# EasyEDA Pro project 嵌入式.eprj, board 显示 (continued)
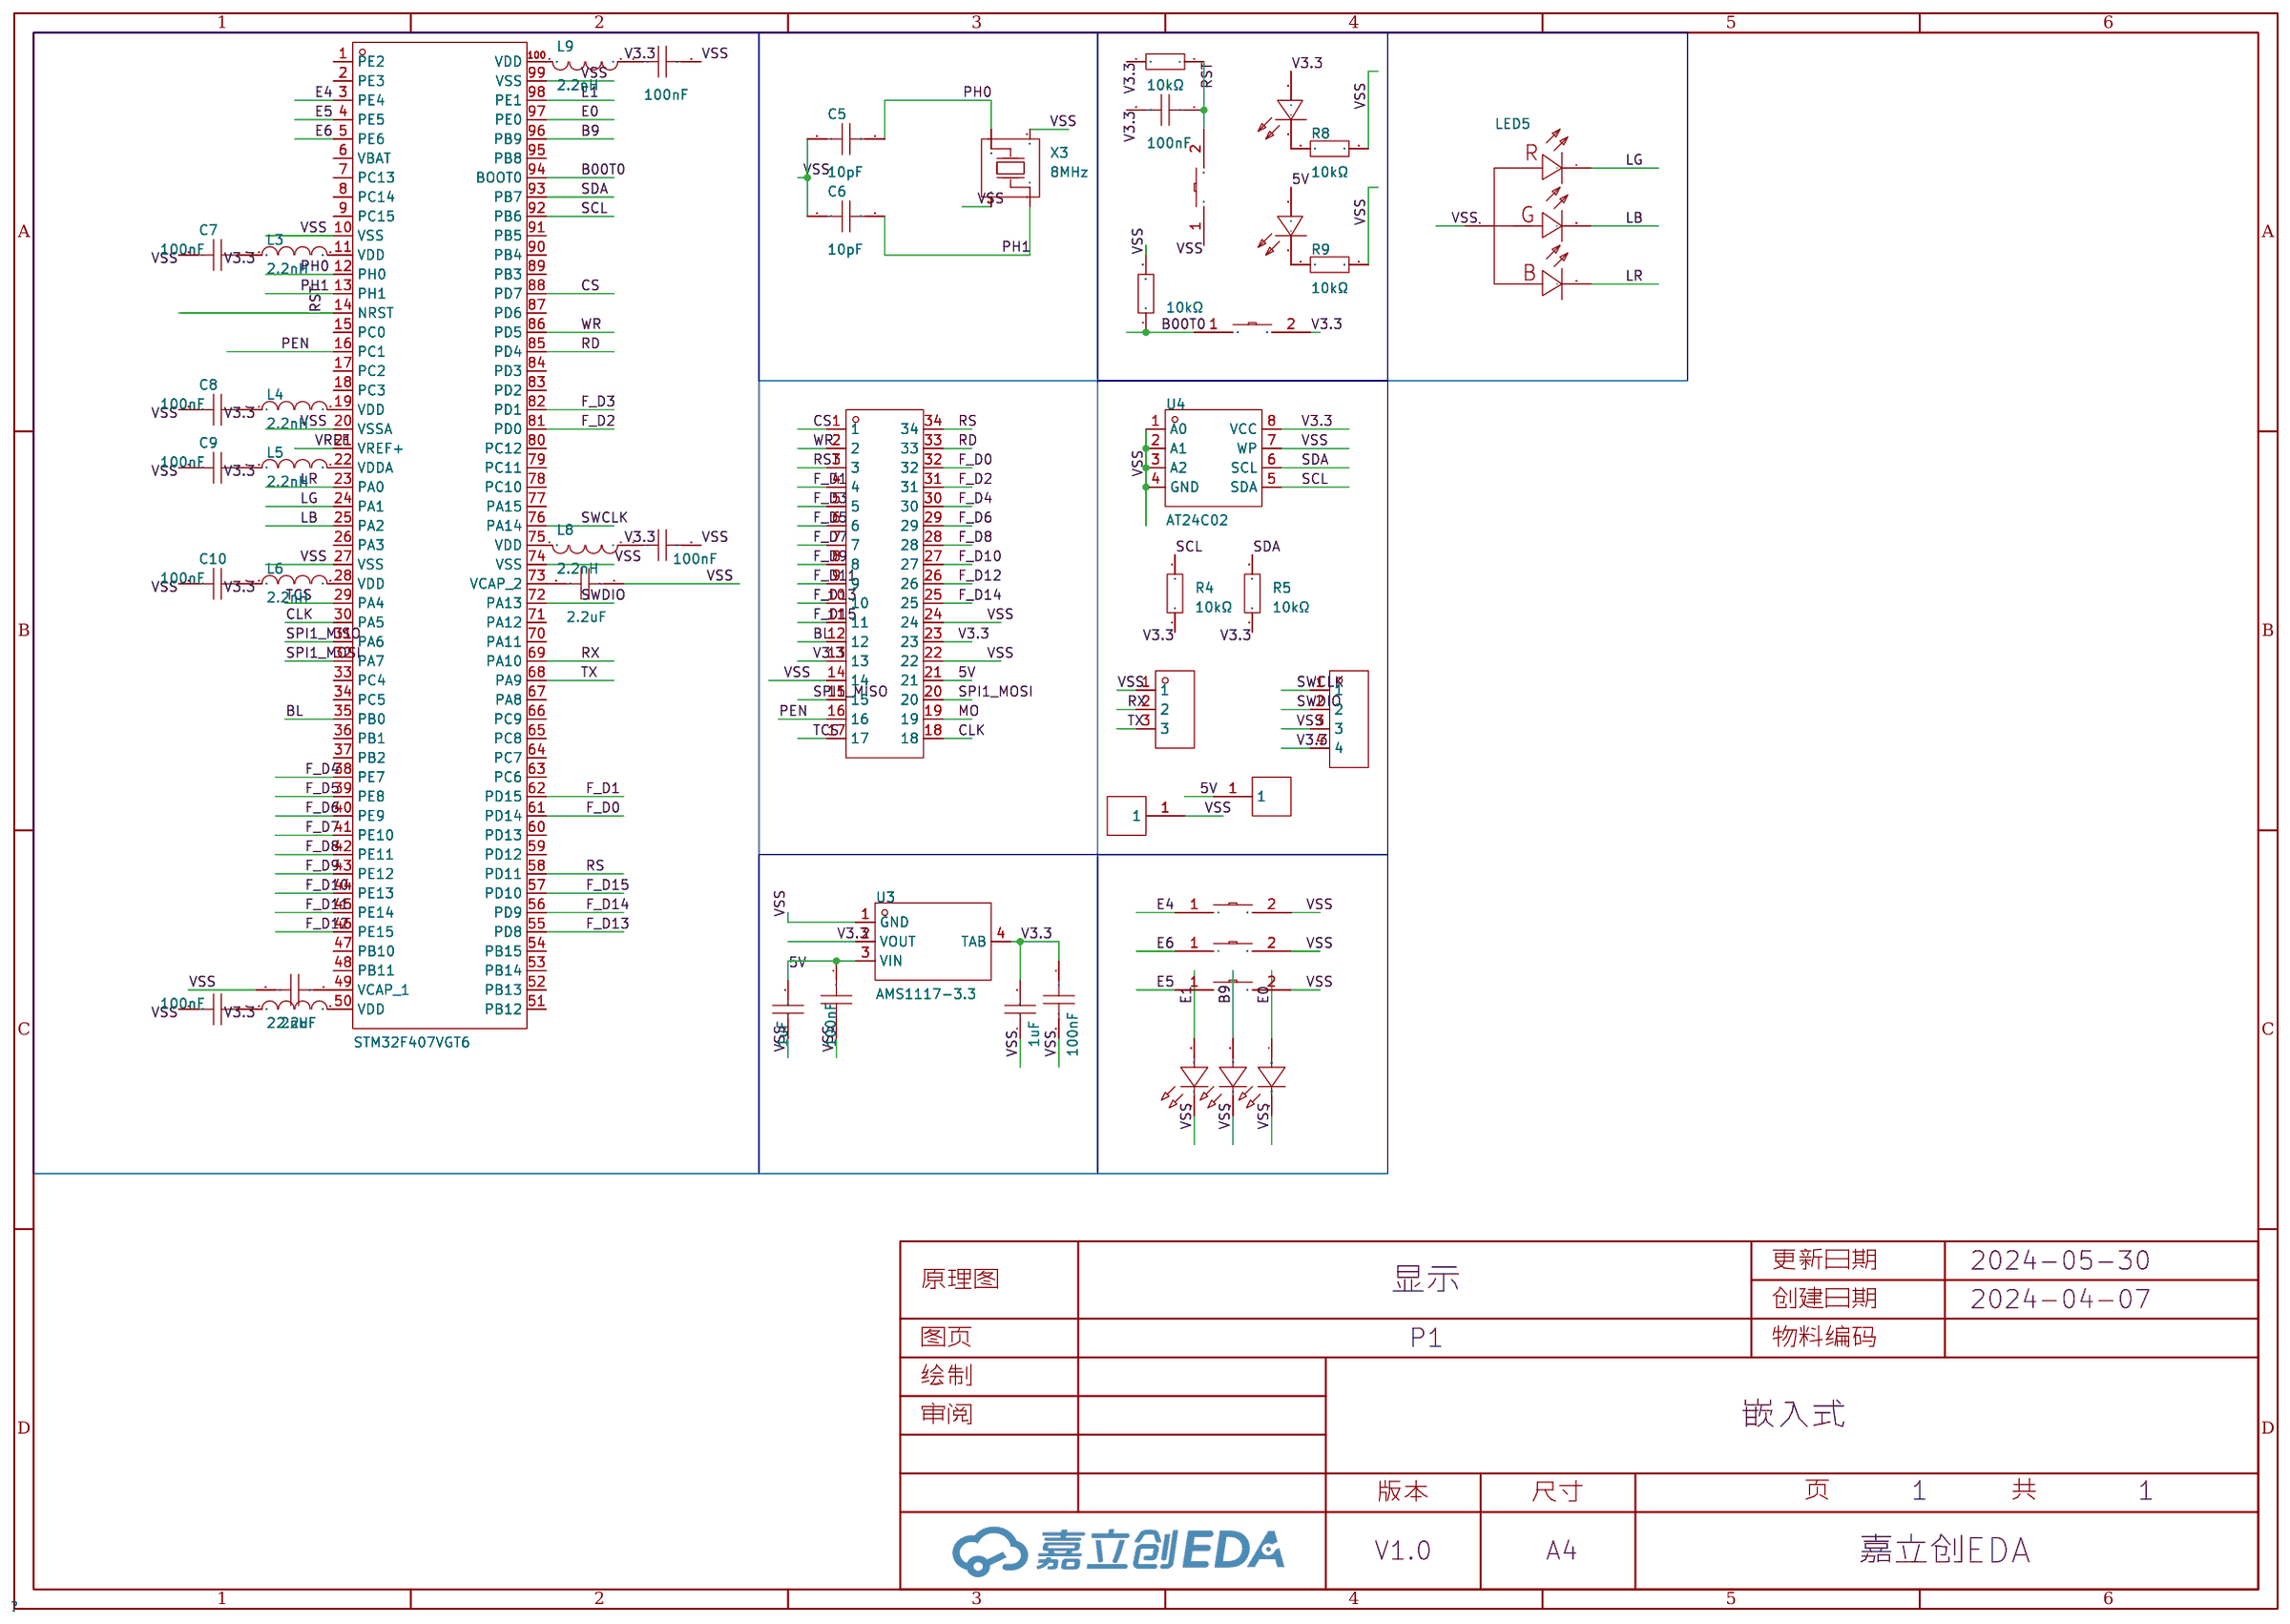
[diagram p0: schematic sheet]
## Routing (per net, layer and track width the routed paths; a pad name or vN(x,y) marks a point on that pad's centre or on a via; arc(x,y) is an arc through that point) (continued)
 v1(37.85,24.43) v1(37.85,23.42) v1(37.85,22.4) v1(37.85,21.39) v1(37.85,20.37) v1(37.85,19.35) v1(37.85,18.34) v1(37.85,17.32) v1(37.85,16.31) v1(37.85,15.29) v1(37.85,14.27) v1(37.85,13.26) v1(37.85,12.24) v1(37.85,11.23) v1(37.85,10.21) v1(37.85,9.19) v1(37.85,8.18) v1(37.85,7.16) v1(37.85,6.15) v1(37.85,5.13) v1(37.85,4.11) v1(37.85,3.1) v1(37.85,2.08) v1(37.85,1.07) v1(38.86,81.33) v1(38.86,78.28) v1(38.86,76.25) v1(38.86,75.23) v1(38.86,70.15) v1(38.86,66.09) v1(38.86,65.07) v1(38.86,58.98) v1(38.86,57.96) v1(38.86,56.95) v1(38.86,55.93) v1(38.86,54.91) v1(38.86,52.88) v1(38.86,51.87) v1(38.86,50.85) v1(38.86,48.82) v1(38.86,47.8) v1(38.86,46.79) v1(38.86,45.77) v1(38.86,38.66) v1(38.86,32.56) v1(38.86,31.55) v1(38.86,30.53) v1(38.86,29.51) v1(38.86,27.48) v1(38.86,26.47) v1(38.86,25.45) v1(38.86,24.43) v1(38.86,23.42) v1(38.86,22.4) v1(38.86,21.39) v1(38.86,20.37) v1(38.86,19.35) v1(38.86,18.34) v1(38.86,17.32) v1(38.86,16.31) v1(38.86,15.29) v1(38.86,14.27) v1(38.86,13.26) v1(38.86,12.24) v1(38.86,11.23) v1(38.86,10.21) v1(38.86,9.19) v1(38.86,8.18) v1(38.86,7.16) v1(38.86,6.15) v1(38.86,5.13) v1(38.86,4.11) v1(38.86,3.1) v1(38.86,2.08) v1(38.86,1.07) v1(39.88,81.33) v1(39.88,75.23) v1(39.88,71.17) v1(39.88,67.11) v1(39.88,66.09) v1(39.88,65.07) v1(39.88,59.99) v1(39.88,58.98) v1(39.88,57.96) v1(39.88,56.95) v1(39.88,55.93) v1(39.88,54.91) v1(39.88,53.9) v1(39.88,52.88) v1(39.88,51.87) v1(39.88,50.85) v1(39.88,48.82) v1(39.88,47.8) v1(39.88,46.79) v1(39.88,45.77) v1(39.88,41.71) v1(39.88,40.69) v1(39.88,37.64) v1(39.88,31.55) v1(39.88,30.53) v1(39.88,29.51) v1(39.88,28.5) v1(39.88,27.48) v1(39.88,26.47) v1(39.88,25.45) v1(39.88,24.43) v1(39.88,23.42) v1(39.88,22.4) v1(39.88,21.39) v1(39.88,20.37) v1(39.88,19.35) v1(39.88,18.34) v1(39.88,17.32) v1(39.88,16.31) v1(39.88,15.29) v1(39.88,14.27) v1(39.88,13.26) v1(39.88,12.24) v1(39.88,11.23) v1(39.88,10.21) v1(39.88,9.19) v1(39.88,8.18) v1(39.88,7.16) v1(39.88,6.15) v1(39.88,5.13) v1(39.88,4.11) v1(39.88,3.1) v1(39.88,2.08) v1(39.88,1.07) v1(40.89,81.33) v1(40.89,68.12) v1(40.89,67.11) v1(40.89,66.09) v1(40.89,65.07) v1(40.89,61.01) v1(40.89,59.99) v1(40.89,58.98) v1(40.89,57.96) v1(40.89,56.95) v1(40.89,55.93) v1(40.89,54.91) v1(40.89,53.9) v1(40.89,52.88) v1(40.89,51.87) v1(40.89,50.85) v1(40.89,48.82) v1(40.89,47.8) v1(40.89,46.79) v1(40.89,45.77) v1(40.89,42.72) v1(40.89,41.71) v1(40.89,40.69) v1(40.89,39.67) v1(40.89,30.53) v1(40.89,29.51) v1(40.89,28.5) v1(40.89,27.48) v1(40.89,26.47) v1(40.89,25.45) v1(40.89,24.43) v1(40.89,23.42) v1(40.89,22.4) v1(40.89,21.39) v1(40.89,20.37) v1(40.89,19.35) v1(40.89,18.34) v1(40.89,17.32) v1(40.89,16.31) v1(40.89,15.29) v1(40.89,14.27) v1(40.89,13.26) v1(40.89,12.24) v1(40.89,11.23) v1(40.89,10.21) v1(40.89,9.19) v1(40.89,8.18) v1(40.89,7.16) v1(40.89,6.15) v1(40.89,5.13) v1(40.89,4.11) v1(40.89,3.1) v1(40.89,2.08) v1(40.89,1.07) v1(41.91,81.33) v1(41.91,78.28) v1(41.91,75.23) v1(41.91,74.22) v1(41.91,73.2) v1(41.91,69.14) v1(41.91,68.12) v1(41.91,67.11) v1(41.91,66.09) v1(41.91,65.07) v1(41.91,61.01) v1(41.91,59.99) v1(41.91,58.98) v1(41.91,57.96) v1(41.91,56.95) v1(41.91,55.93) v1(41.91,54.91) v1(41.91,53.9) v1(41.91,52.88) v1(41.91,51.87) v1(41.91,50.85) v1(41.91,48.82) v1(41.91,47.8) v1(41.91,46.79) v1(41.91,45.77) v1(41.91,42.72) v1(41.91,41.71) v1(41.91,40.69) v1(41.91,39.67) v1(41.91,38.66) v1(41.91,35.61) v1(41.91,30.53) v1(41.91,29.51) v1(41.91,28.5) v1(41.91,27.48) v1(41.91,26.47) v1(41.91,25.45) v1(41.91,24.43) v1(41.91,23.42) v1(41.91,22.4) v1(41.91,21.39) v1(41.91,20.37) v1(41.91,19.35) v1(41.91,18.34) v1(41.91,17.32) v1(41.91,16.31) v1(41.91,15.29) v1(41.91,14.27) v1(41.91,13.26) v1(41.91,12.24) v1(41.91,11.23) v1(41.91,10.21) v1(41.91,9.19) v1(41.91,8.18) v1(41.91,7.16) v1(41.91,6.15) v1(41.91,5.13) v1(41.91,4.11) v1(41.91,3.1) v1(41.91,2.08) v1(41.91,1.07) v1(42.93,81.33) v1(42.93,75.23) v1(42.93,74.22) v1(42.93,70.15) v1(42.93,69.14) v1(42.93,68.12) v1(42.93,67.11) v1(42.93,66.09) v1(42.93,61.01) v1(42.93,59.99) v1(42.93,58.98) v1(42.93,57.96) v1(42.93,56.95) v1(42.93,55.93) v1(42.93,54.91) v1(42.93,53.9) v1(42.93,52.88) v1(42.93,51.87) v1(42.93,50.85) v1(42.93,48.82) v1(42.93,47.8) v1(42.93,46.79) v1(42.93,42.72) v1(42.93,41.71) v1(42.93,40.69) v1(42.93,39.67) v1(42.93,38.66) v1(42.93,34.59) v1(42.93,29.51) v1(42.93,28.5) v1(42.93,27.48) v1(42.93,26.47) v1(42.93,25.45) v1(42.93,24.43) v1(42.93,23.42) v1(42.93,22.4) v1(42.93,21.39) v1(42.93,20.37) v1(42.93,19.35) v1(42.93,18.34) v1(42.93,17.32) v1(42.93,16.31) v1(42.93,15.29) v1(42.93,14.27) v1(42.93,13.26) v1(42.93,12.24) v1(42.93,11.23) v1(42.93,10.21) v1(42.93,9.19) v1(42.93,8.18) v1(42.93,7.16) v1(42.93,6.15) v1(42.93,5.13) v1(42.93,4.11) v1(42.93,3.1) v1(42.93,2.08) v1(42.93,1.07) v1(43.94,81.33) v1(43.94,75.23) v1(43.94,70.15) v1(43.94,69.14) v1(43.94,68.12) v1(43.94,67.11) v1(43.94,61.01) v1(43.94,59.99) v1(43.94,58.98) v1(43.94,57.96) v1(43.94,56.95) v1(43.94,55.93) v1(43.94,54.91) v1(43.94,53.9) v1(43.94,52.88) v1(43.94,51.87) v1(43.94,50.85) v1(43.94,48.82) v1(43.94,47.8) v1(43.94,46.79) v1(43.94,42.72) v1(43.94,41.71) v1(43.94,40.69) v1(43.94,39.67) v1(43.94,38.66) v1(43.94,33.58) v1(43.94,28.5) v1(43.94,27.48) v1(43.94,26.47) v1(43.94,25.45) v1(43.94,24.43) v1(43.94,23.42) v1(43.94,22.4) v1(43.94,21.39) v1(43.94,20.37) v1(43.94,19.35) v1(43.94,18.34) v1(43.94,17.32) v1(43.94,16.31) v1(43.94,15.29) v1(43.94,14.27) v1(43.94,13.26) v1(43.94,12.24) v1(43.94,11.23) v1(43.94,10.21) v1(43.94,9.19) v1(43.94,8.18) v1(43.94,7.16) v1(43.94,6.15) v1(43.94,5.13) v1(43.94,4.11) v1(43.94,3.1) v1(43.94,2.08) v1(43.94,1.07) v1(44.96,81.33) v1(44.96,72.19) v1(44.96,70.15) v1(44.96,69.14) v1(44.96,68.12) v1(44.96,65.07) v1(44.96,61.01) v1(44.96,59.99) v1(44.96,58.98) v1(44.96,57.96) v1(44.96,56.95) v1(44.96,55.93) v1(44.96,54.91) v1(44.96,53.9) v1(44.96,52.88) v1(44.96,51.87) v1(44.96,50.85) v1(44.96,48.82) v1(44.96,47.8) v1(44.96,46.79) v1(44.96,42.72) v1(44.96,41.71) v1(44.96,40.69) v1(44.96,39.67) v1(44.96,38.66) v1(44.96,32.56) v1(44.96,27.48) v1(44.96,26.47) v1(44.96,25.45) v1(44.96,24.43) v1(44.96,23.42) v1(44.96,22.4) v1(44.96,21.39) v1(44.96,20.37) v1(44.96,19.35) v1(44.96,18.34) v1(44.96,17.32) v1(44.96,16.31) v1(44.96,15.29) v1(44.96,14.27) v1(44.96,13.26) v1(44.96,12.24) v1(44.96,11.23) v1(44.96,10.21) v1(44.96,9.19) v1(44.96,8.18) v1(44.96,7.16) v1(44.96,6.15) v1(44.96,5.13) v1(44.96,4.11) v1(44.96,3.1) v1(44.96,2.08) v1(44.96,1.07) v1(45.97,81.33) v1(45.97,73.2) v1(45.97,72.19) v1(45.97,70.15) v1(45.97,69.14) v1(45.97,66.09) v1(45.97,65.07) v1(45.97,61.01) v1(45.97,59.99) v1(45.97,58.98) v1(45.97,57.96) v1(45.97,56.95) v1(45.97,55.93) v1(45.97,54.91) v1(45.97,53.9) v1(45.97,52.88) v1(45.97,51.87) v1(45.97,50.85) v1(45.97,48.82) v1(45.97,47.8) v1(45.97,46.79) v1(45.97,45.77) v1(45.97,43.74) v1(45.97,42.72) v1(45.97,41.71) v1(45.97,40.69) v1(45.97,39.67) v1(45.97,38.66) v1(45.97,37.64) v1(45.97,36.63) v1(45.97,35.61) v1(45.97,34.59) v1(45.97,31.55) v1(45.97,26.47) v1(45.97,25.45) v1(45.97,24.43) v1(45.97,23.42) v1(45.97,22.4) v1(45.97,21.39) v1(45.97,20.37) v1(45.97,19.35) v1(45.97,18.34) v1(45.97,17.32) v1(45.97,16.31) v1(45.97,15.29) v1(45.97,14.27) v1(45.97,13.26) v1(45.97,12.24) v1(45.97,11.23) v1(45.97,10.21) v1(45.97,9.19) v1(45.97,8.18) v1(45.97,7.16) v1(45.97,6.15) v1(45.97,5.13) v1(45.97,1.07) v1(46.99,81.33) v1(46.99,78.28) v1(46.99,76.25) v1(46.99,75.23) v1(46.99,74.22) v1(46.99,73.2) v1(46.99,72.19) v1(46.99,70.15) v1(46.99,67.11) v1(46.99,66.09) v1(46.99,65.07) v1(46.99,61.01) v1(46.99,59.99) v1(46.99,58.98) v1(46.99,57.96) v1(46.99,56.95) v1(46.99,55.93) v1(46.99,54.91) v1(46.99,53.9) v1(46.99,52.88) v1(46.99,51.87) v1(46.99,50.85) v1(46.99,48.82) v1(46.99,47.8) v1(46.99,46.79) v1(46.99,45.77) v1(46.99,43.74) v1(46.99,42.72) v1(46.99,41.71) v1(46.99,40.69) v1(46.99,39.67) v1(46.99,38.66) v1(46.99,37.64) v1(46.99,36.63) v1(46.99,35.61) v1(46.99,34.59) v1(46.99,33.58) v1(46.99,30.53) v1(46.99,25.45) v1(46.99,24.43) v1(46.99,23.42) v1(46.99,22.4) v1(46.99,21.39) v1(46.99,20.37) v1(46.99,19.35) v1(46.99,18.34) v1(46.99,17.32) v1(46.99,16.31) v1(46.99,15.29) v1(46.99,14.27) v1(46.99,13.26) v1(46.99,12.24) v1(46.99,11.23) v1(46.99,10.21) v1(46.99,9.19) v1(46.99,8.18) v1(46.99,7.16) v1(46.99,6.15) v1(48.01,81.33) v1(48.01,80.31) v1(48.01,79.3) v1(48.01,78.28) v1(48.01,77.27) v1(48.01,76.25) v1(48.01,75.23) v1(48.01,74.22) v1(48.01,73.2) v1(48.01,72.19) v1(48.01,68.12) v1(48.01,67.11) v1(48.01,66.09) v1(48.01,65.07) v1(48.01,61.01) v1(48.01,59.99) v1(48.01,58.98) v1(48.01,57.96) v1(48.01,56.95) v1(48.01,55.93) v1(48.01,54.91) v1(48.01,53.9) v1(48.01,52.88) v1(48.01,51.87) v1(48.01,50.85) v1(48.01,48.82) v1(48.01,47.8) v1(48.01,46.79) v1(48.01,45.77) v1(48.01,44.75) v1(48.01,42.72) v1(48.01,41.71) v1(48.01,40.69) v1(48.01,39.67) v1(48.01,38.66) v1(48.01,37.64) v1(48.01,36.63) v1(48.01,35.61) v1(48.01,34.59) v1(48.01,33.58) v1(48.01,32.56) v1(48.01,29.51) v1(48.01,24.43) v1(48.01,23.42) v1(48.01,22.4) v1(48.01,21.39) v1(48.01,20.37) v1(48.01,19.35) v1(48.01,18.34) v1(48.01,17.32) v1(48.01,16.31) v1(48.01,15.29) v1(48.01,14.27) v1(48.01,13.26) v1(48.01,12.24) v1(48.01,11.23) v1(48.01,10.21) v1(48.01,9.19) v1(48.01,8.18) v1(48.01,7.16) v1(48.01,6.15) v1(49.02,81.33) v1(49.02,80.31) v1(49.02,79.3) v1(49.02,78.28) v1(49.02,77.27) v1(49.02,76.25) v1(49.02,75.23) v1(49.02,74.22) v1(49.02,73.2) v1(49.02,69.14) v1(49.02,68.12) v1(49.02,67.11) v1(49.02,66.09) v1(49.02,65.07) v1(49.02,61.01) v1(49.02,59.99) v1(49.02,58.98) v1(49.02,57.96) v1(49.02,56.95) v1(49.02,55.93) v1(49.02,54.91) v1(49.02,53.9) v1(49.02,52.88) v1(49.02,51.87) v1(49.02,50.85) v1(49.02,48.82) v1(49.02,47.8) v1(49.02,46.79) v1(49.02,45.77) v1(49.02,44.75) v1(49.02,43.74) v1(49.02,41.71) v1(49.02,40.69) v1(49.02,39.67) v1(49.02,38.66) v1(49.02,37.64) v1(49.02,36.63) v1(49.02,35.61) v1(49.02,34.59) v1(49.02,33.58) v1(49.02,32.56) v1(49.02,31.55) v1(49.02,28.5) v1(49.02,23.42) v1(49.02,22.4) v1(49.02,21.39) v1(49.02,20.37) v1(49.02,19.35) v1(49.02,18.34) v1(49.02,17.32) v1(49.02,16.31) v1(49.02,15.29) v1(49.02,14.27) v1(49.02,13.26) v1(49.02,12.24) v1(49.02,11.23) v1(49.02,10.21) v1(49.02,9.19) v1(49.02,8.18) v1(49.02,7.16) v1(49.02,6.15) v1(50.04,81.33) v1(50.04,80.31) v1(50.04,79.3) v1(50.04,78.28) v1(50.04,77.27) v1(50.04,76.25) v1(50.04,75.23) v1(50.04,74.22) v1(50.04,69.14) v1(50.04,68.12) v1(50.04,67.11) v1(50.04,66.09) v1(50.04,65.07) v1(50.04,61.01) v1(50.04,59.99) v1(50.04,58.98) v1(50.04,57.96) v1(50.04,56.95) v1(50.04,55.93) v1(50.04,54.91) v1(50.04,53.9) v1(50.04,52.88) v1(50.04,51.87) v1(50.04,50.85) v1(50.04,48.82) v1(50.04,47.8) v1(50.04,46.79) v1(50.04,45.77) v1(50.04,44.75) v1(50.04,43.74) v1(50.04,42.72) v1(50.04,40.69) v1(50.04,39.67) v1(50.04,38.66) v1(50.04,37.64) v1(50.04,36.63) v1(50.04,35.61) v1(50.04,34.59) v1(50.04,33.58) v1(50.04,32.56) v1(50.04,31.55) v1(50.04,30.53) v1(50.04,27.48) v1(50.04,22.4) v1(50.04,21.39) v1(50.04,20.37) v1(50.04,19.35) v1(50.04,18.34) v1(50.04,17.32) v1(50.04,16.31) v1(50.04,15.29) v1(50.04,14.27) v1(50.04,13.26) v1(50.04,12.24) v1(50.04,11.23) v1(50.04,10.21) v1(50.04,9.19) v1(50.04,8.18) v1(50.04,7.16) v1(50.04,6.15) v1(50.04,5.13) v1(50.04,1.07) v2(3.67,64.54) v2(6.31,64.54) v2(8.68,64.54) v2(10.41,64.54) v2(12.64,64.54) v2(14.79,64.54) v2(16.99,3.63) v2(17.24,64.54) v2(18.46,64.54) v2(22.31,64.54) v2(24.44,64.54) v2(24.99,49.78) v2(26.44,44.6) v2(27.38,64.74) v2(29.24,41.43) v2(33.71,64.59) v2(35.79,64.59) v2(38.53,64.59) v2(41.02,64.59) v2(45.38,64.59) v2(47.92,64.59)
B00T0: length 12.8
  Top Layer w0.165: U1.94 36.11,36.89 R7.1 43.89,36.89 SW3.1
B9: length 45.5
  Top Layer w0.165: 33.31,41.1 34.39,40.02 v2(34.39,39.45) ; v2(52.55,5.33) 54.24,5.33 LED1.5
  Inner1 w0.165: v2(34.39,39.45) 52.55,21.28 v2(52.55,5.33)
BL: length 33.6
  Top Layer w0.165: U1.35 19.43,51.45 19.43,56.06 33.12,69.75 U2.12
CLK: length 40.6
  Top Layer w0.165: v2(23.55,50.32) 23.55,50.87 U1.30
  Inner2 w0.165: U2.18 44.5,78.55 44.5,74.12 23.55,53.16 v2(23.55,50.32)
CS: length 70.4
  Top Layer w0.165: U1.88 30.61,38.27 v2(32.26,36.63)
  Inner2 w0.165: v2(32.26,36.63) 28.35,32.71 14.27,32.71 5.18,41.81 U2.1
E0: length 42.8
  Top Layer w0.165: U1.97 v2(35.22,39.9) 35.23,39.9
  Inner1 w0.165: v2(35.22,39.9) 53.98,21.15 53.98,7.03
  vias: v2(53.97,6.98)
E1: length 46.8
  Top Layer w0.165: U1.98 35.34,40.49 v2(35.51,40.49)
  Inner1 w0.165: v2(35.51,40.49) 54.74,21.26 54.74,3.73
  vias: v2(54.74,3.95)
E4: length 40.3
  Top Layer w0.165: U1.3 31.86,43.26 v2(30.76,43.26)
  Inner1 w0.165: v2(30.76,43.26) 35.97,43.26 v2(57.86,21.36)
E5: length 36.6
  Top Layer w0.165: v2(30.1,44.86) 30.71,44.25 32.14,44.25 U1.4
  Inner1 w0.165: 57.84,34.09 47.07,44.86 v2(30.1,44.86)
  vias: v2(57.89,34.09)
E6: length 35.2
  Top Layer w0.165: 33.31,46.12 32.35,45.16 31.37,45.16 v2(30.58,45.95)
  Inner1 w0.165: v2(58.09,46.02) 58.09,48.21 56.72,49.58 34.21,49.58 v2(30.58,45.95)
F_D0: length 51
  Top Layer w0.165: U1.61 16.52,36.4 v2(16.38,36.4)
  Bottom Layer w0.165: U2.32 11.53,78.6 11.53,44.32 10.11,42.9 10.11,42.67 v2(16.38,36.4)
F_D1: length 44.1
  Top Layer w0.165: 19.45,38.63 19.45,38.53 v2(18.42,37.49)
  Bottom Layer w0.165: v2(18.42,37.49) 17.73,37.49 13.67,41.55 13.67,76.47 U2.4
F_D2: length 54.5
  Top Layer w0.165: v2(26.9,36.8) 27.91,35.8 U1.81
  Bottom Layer w0.165: v2(26.9,36.8) 25.5,35.41 23.29,35.41 14.15,44.55 14.15,78.52 U2.31
F_D3: length 50.3
  Top Layer w0.165: v2(26.57,37.72) 26.8,37.72 U1.82
  Bottom Layer w0.165: v2(26.57,37.72) 25.6,36.75 22.83,36.75 15.34,44.25 U2.5
F_D4: length 49.6
  Top Layer w0.165: v2(22.58,46.68) 22.07,46.68 U1.38
  Bottom Layer w0.165: v2(22.58,46.68) 22.58,44.45 21.03,42.9 17.45,42.9 16.61,43.74 16.61,78.6 U2.30
F_D5: length 43.2
  Top Layer w0.165: 19.45,48.6 19.45,48.54 v2(21.95,46.05)
  Bottom Layer w0.165: v2(21.95,46.05) 22.02,45.97 22.02,44.96 20.32,43.26 18.67,43.26 17.88,44.04 U2.6
F_D6: length 32.6
  Top Layer w0.165: U1.40 18.41,48.93 18.41,49.33 v2(18.36,49.38)
  Bottom Layer w0.165: U2.29 18.96,78.78 18.96,49.98 v2(18.36,49.38)
F_D7: length 32.1
  Top Layer w0.165: v2(19.89,46.94) 19.53,47.29 19.34,47.29 U1.41
  Bottom Layer w0.165: v2(19.89,46.94) 20.42,47.47 U2.7
F_D8: length 36.3
  Top Layer w0.165: v2(19.84,46.2) 18.5,47.54 18.39,47.54
  Bottom Layer w0.165: v2(19.84,46.2) 19.3,46.73 19.3,78.75 U2.28
F_D9: length 37
  Top Layer w0.165: U1.43 20.39,44.83 v2(20.5,44.83)
  Bottom Layer w0.165: v2(20.5,44.83) 21.41,45.74 21.41,75.78 U2.8
F_D10: length 39
  Top Layer w0.165: v2(19.61,44.93) 17.71,46.83 U1.44
  Bottom Layer w0.165: v2(19.61,44.93) 20.93,46.25 20.93,76.1 21.69,76.86 21.69,78.6 U2.27
F_D11: length 34.8
  Top Layer w0.165: U1.45 16.64,47.17 16.64,68.53 25.44,77.33 U2.9
F_D12: length 38
  Top Layer w0.165: U2.26 24.23,78.6 24.23,76.83 16.15,68.76 16.15,46.95 16.98,46.12
F_D13: length 41.8
  Top Layer w0.165: v2(19.41,41.88) 17.76,41.88 16.98,41.1
  Inner1 w0.165: U2.10 28.04,50.52 v2(19.41,41.88)
F_D14: length 46.6
  Top Layer w0.165: U1.56 17.33,40.75 v2(16.31,39.72)
  Inner1 w0.165: v2(16.31,39.72) 26.71,50.13 26.71,77.53 26.54,77.7 26.54,78.37 U2.25
F_D15: length 43.1
  Top Layer w0.165: v2(19.68,40.97) 18.26,40.97 U1.57
  Inner1 w0.165: v2(19.68,40.97) 28.7,49.99 28.7,57.5 30.58,59.38 U2.11
LB: length 37.7
  Top Layer w0.165: 26.24,53.19 24.99,51.94 v2(24.99,51.54)
  Inner2 w0.165: 55.04,63.65 36.3,63.65 24.99,52.35 v2(24.99,51.54)
  vias: v2(55.09,63.65)
LG: length 40.5
  Top Layer w0.165: v2(25.76,51.66) 25.76,52 U1.24
  Inner2 w0.165: v2(55.22,64.9) 55.8,64.9 56.52,64.19 56.52,63.07 56.08,62.64 36.2,62.64 31.04,57.48 31.04,56.08 26.62,51.66 v2(25.76,51.66)
LR: length 40
  Top Layer w0.165: v2(25.81,50.75) 26.26,51.2 26.26,51.79 26.95,52.48
  Inner2 w0.165: v2(25.81,50.75) 27.41,50.75 38.63,61.97 56.31,61.97 58.06,63.73 v2(58.27,63.73)
PEN: length 33.1
  Top Layer w0.165: U1.16 30.25,50.84 v2(30.25,50.95)
  Inner1 w0.165: 30.28,50.9 30.94,51.56 30.94,64.99 U2.16
PH0: length 10.1
  Top Layer w0.165: 30.84,48.6 33.21,50.96 C5.2 36.18,50.96 37.46,52.25 X3.3
PH1: length 7.9
  Top Layer w0.165: X3.1 33.79,54.56 C6.2 32.63,51.09 U1.13
RD: length 53.3
  Top Layer w0.165: U1.85 29.02,37.62 28.98,37.62 26.04,40.56 v2(26.04,40.61)
  Inner2 w0.165: U2.33 9.17,78.42 9.17,54.66 23.22,40.61 v2(26.04,40.61)
RS: length 58.6
  Top Layer w0.165: v2(14.88,36.88) 18.04,40.03 U1.58
  Inner1 w0.165: v2(14.88,36.88) 14.33,36.32 9.04,36.32 1.7,43.66 1.7,76.39 U2.34
RST: length 98.8
  Top Layer w0.165: U2.3 11.66,78.73 11.66,80.72 13.16,82.22 52.6,82.22 58.34,76.48 v3(58.34,72.29) ; U1.14 30.77,49.94 30.77,55.4 v3(32.54,57.17)
  Bottom Layer w0.165: v3(58.34,72.29) 56.9,70.84 R6.1 50.96,70.27 C22.1 35.43,57.17 v3(32.54,57.17)
RX: length 36.7
  Top Layer w0.165: CN1.2 18.01,9.73 15.04,9.73 13.21,11.56 13.21,27.43 U1.69
SCL: length 13.7
  Top Layer w0.165: R4.2 33.91,29.67 34.92,30.68 34.92,36.66 31.9,39.69
SDA: length 15
  Top Layer w0.165: U1.93 36.25,36.05 36.25,30.21 U4.6 33.92,27.89 R5.2
SPI1_MISO: length 36.7
  Top Layer w0.165: U1.31 23.01,50.69 v2(23.01,49.83)
  Inner2 w0.165: v2(23.01,49.83) 23.01,55.02 40.74,72.74 U2.15
SPI1_MOSI: length 40.2
  Top Layer w0.165: v2(22.53,49.28) 22.53,50.47 U1.32
  Inner2 w0.165: v2(22.53,49.28) 22.53,55.88 39.37,72.72 39.37,78.5 U2.20
SWCLK: length 30.3
  Top Layer w0.165: 26.24,34.03 29.01,31.27 29.01,26.08 35.18,19.91 H1.1
SWDIO: length 35.8
  Top Layer w0.165: H1.2 32.49,7.57 32.49,16.94 29.52,19.91 27.03,19.91 19.74,27.2 19.74,31.84 U1.72
TCS: length 37
  Top Layer w0.165: U1.29 24.05,51.07 v2(24.05,50.98)
  Inner2 w0.165: U2.17 45.82,73.81 24.05,52.04 v2(24.05,50.98)
TX: length 36
  Top Layer w0.165: U1.68 12.32,27.25 12.32,10.84 15.49,7.67 CN1.3
WR: length 51.6
  Top Layer w0.165: U1.86 29.74,37.57 v2(27.74,39.57)
  Inner2 w0.165: v2(27.74,39.57) 23.14,39.57 7.72,54.99 U2.2
$1N1272: length 2.5
  Top Layer w0.254: U1.11 32.01,49.06 L3.2
$1N1364: length 3.2
  Top Layer w0.254: 29.45,53.78 29.45,52.16 U1.19
$1N1443: length 4.5
  Top Layer w0.254: U1.22 27.99,52.82 27.99,53.26 26.66,54.6 26.66,55.82
$1N1522: length 2.1
  Top Layer w0.254: 23.34,52.48 21.98,53.84 L6.2
$1N1678: length 1.6
  Top Layer w0.254: 15.57,44.71 14.6,43.74 L7.2
$1N1757: length 1.4
  Top Layer w0.254: 24.05,34.03 24.88,33.2 24.88,32.93
$1N1836: length 2.1
  Top Layer w0.254: U1.100 36.01,42.52 36.59,43.09
$1N1892: length 4.6
  Top Layer w0.254: 23.34,34.74 21.62,33.01 C14.2
$1N1928: length 3.7
  Top Layer w0.254: U1.49 14.07,46.91 C15.1
$1N4552: length 2.9
  Top Layer w0.165: LED2.2 16.17,15.54 R8.2
$1N4591: length 2.8
  Top Layer w0.165: LED3.2 R9.2

## Copper pours and planes (outline as drawn; the poured copper is in the pictures)
VSS on Top Layer: -2.51,90.53 63.98,90.53 63.98,-5.84 -2.51,-5.84
VSS on Bottom Layer: -8.46,90.53 63.65,90.53 63.65,-2.29 -8.46,-2.29
VSS on Inner1: -5.08,90.02 65.35,90.02 65.35,-2.79 -5.08,-2.79
VSS on Inner2: -8.64,86.79 67.72,86.79 67.72,-3.81 -8.64,-3.81

## Text on the board
Bottom Silkscreen Layer: 5V | GND | 2024+共创芯未来
Top Layer: RGB
Top Silkscreen Layer: TX RX GND | usart1 | 3.3 GND SWD SWC | PC1 | E0 B9 E1 | 5V | GND | BOOT0 | RGB | E6 | E5 | E4 | RESET | 显示板 | 2024+共创芯未来
